# EasyEDA Pro project 111智能加湿器.eprj (continued)
## Notes on the sheets (continued)
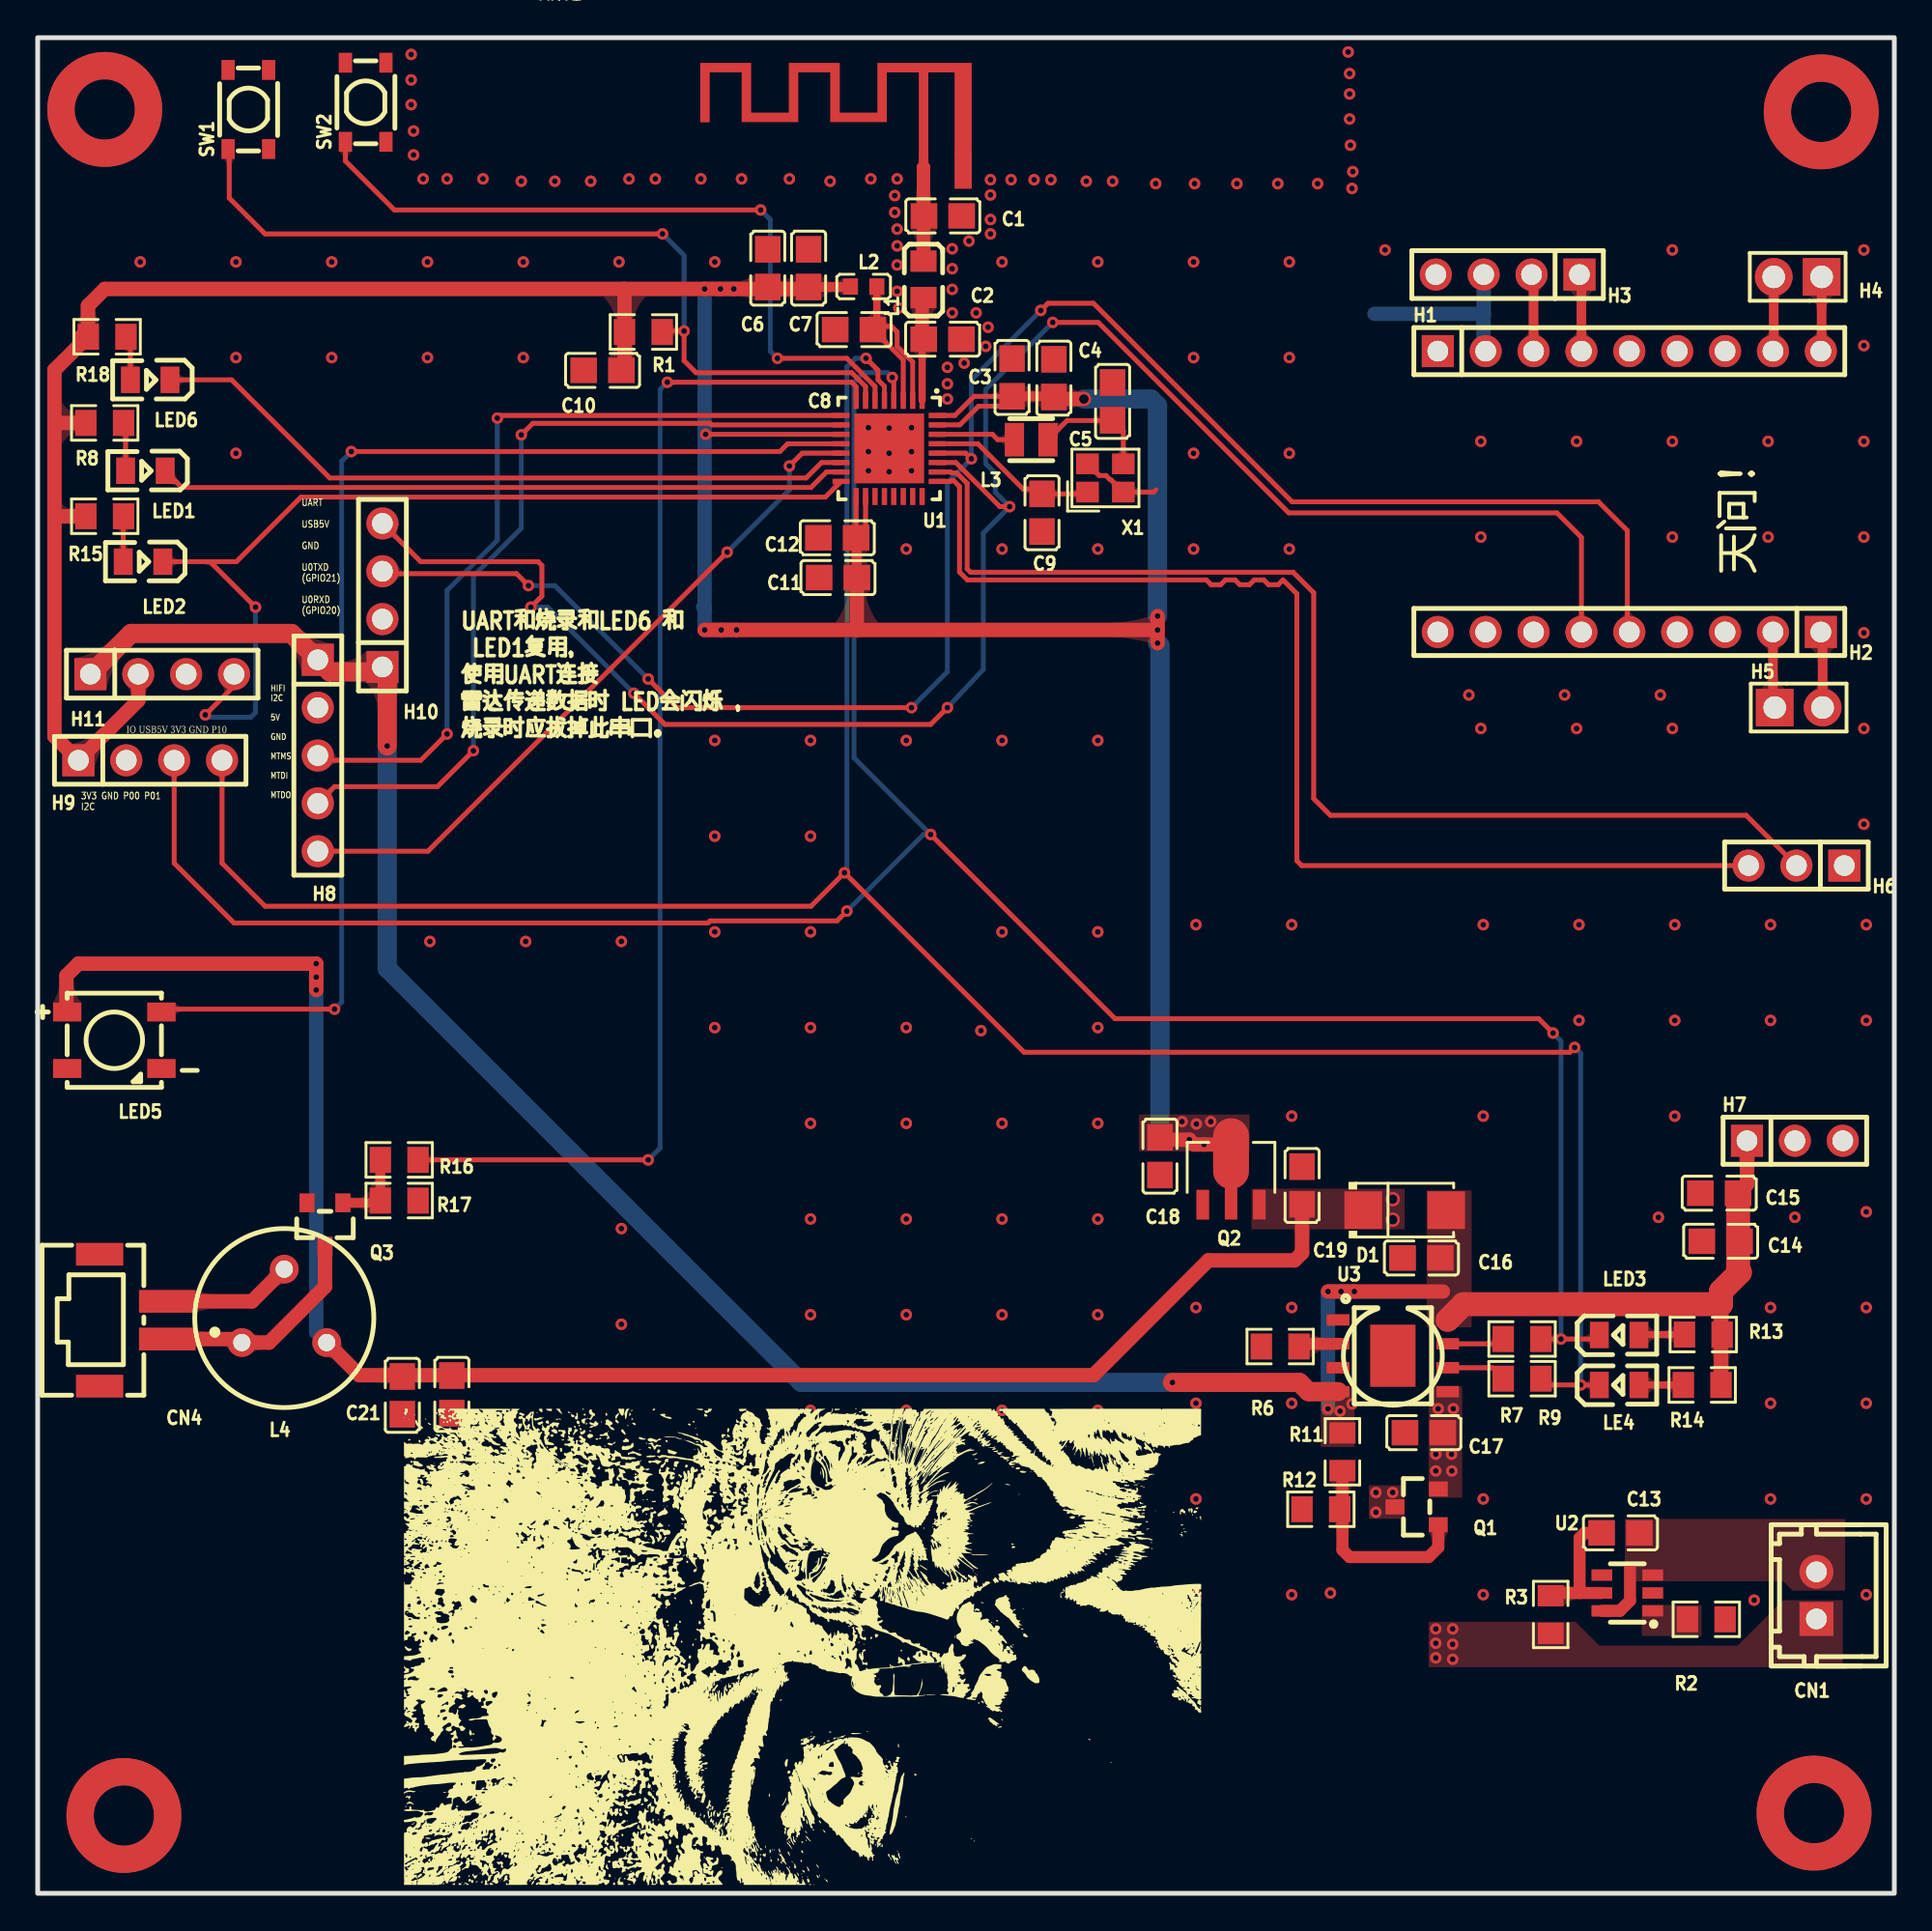
[diagram p3: board, top side]
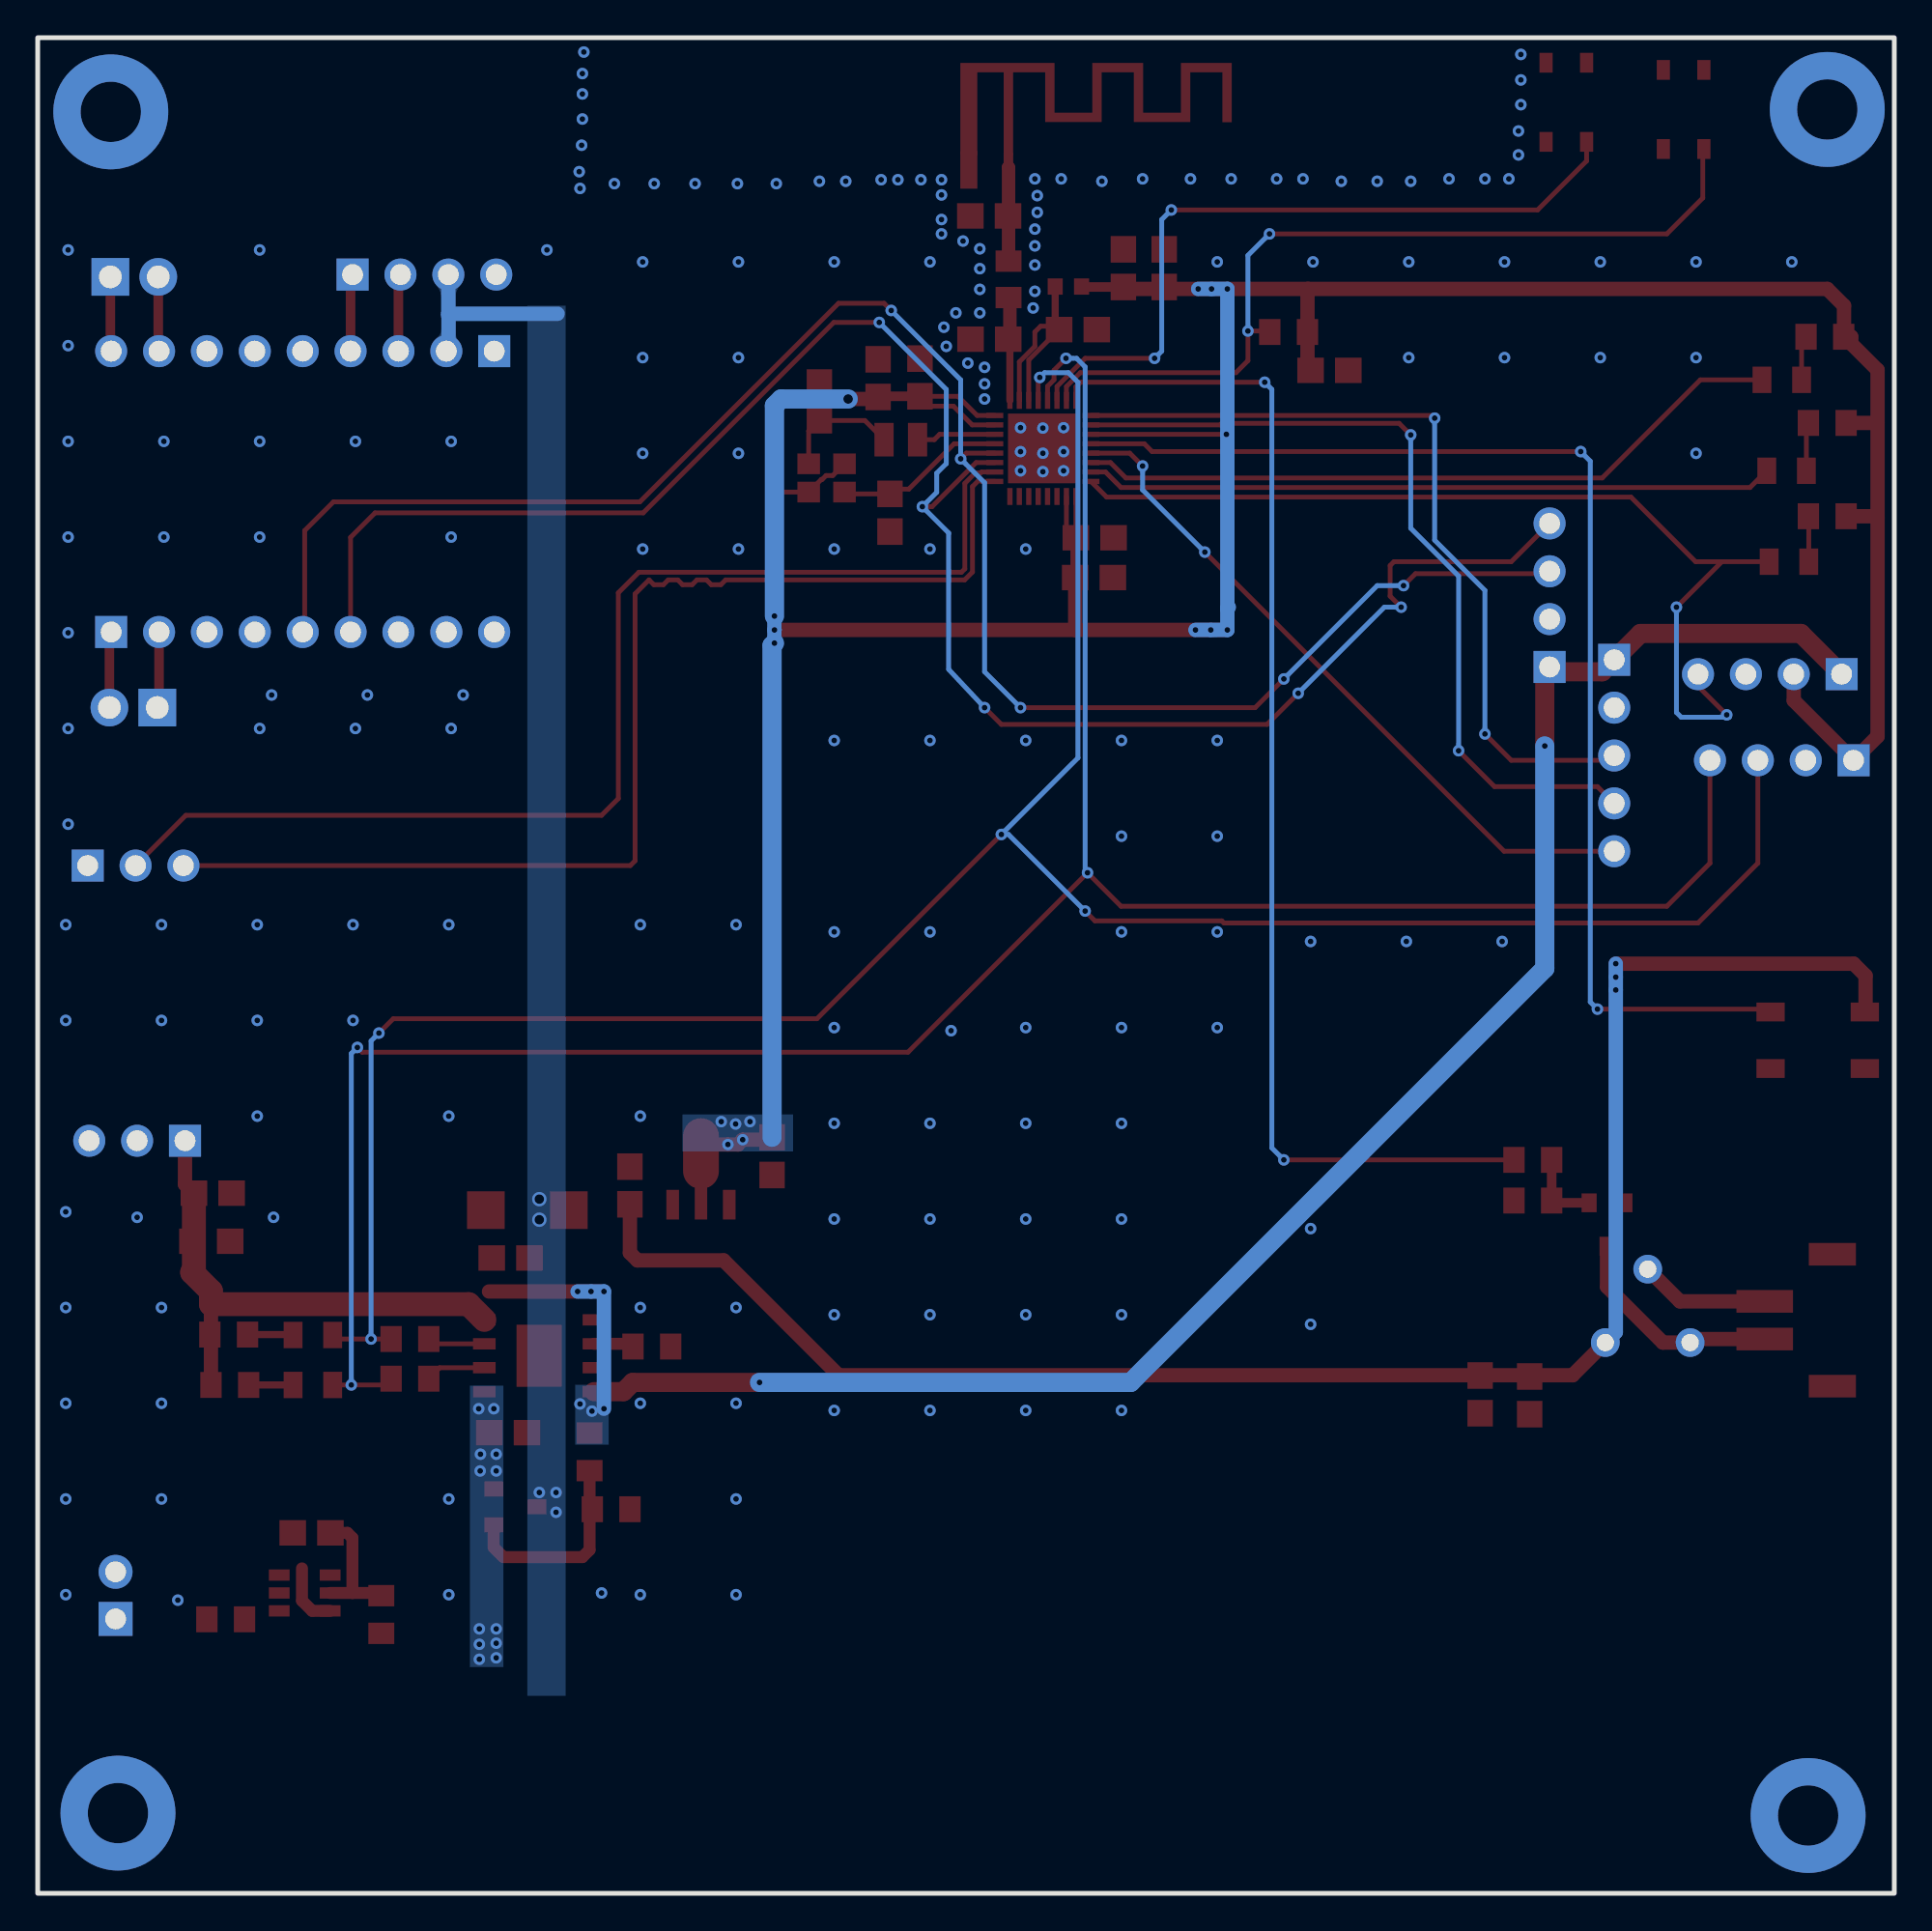
[diagram p4: board, bottom side, seen from below]

Outline 98.49 x 98.49 mm; copper layers: Top Layer, Bottom Layer. Coordinates in mm from the lower left corner of the outline.
Outline path: rectangle 0,98.49 98.49,0
Stack: Top Layer 0.035mm / Dielectric1 1.51mm FR4 er 4.5 / Bottom Layer 0.035mm

## Design rules (mm)
net P19: DP1
net P18: DP1
template: JLCPCB Capability(Two Layers Board)
spacing copperThickness1oz (default): track to track 0.102, other pairs 0.152 to 0.3
spacing copperThickness2oz: track to track 0.203, other pairs 0.152 to 0.3
track width copperThickness1oz (default): min 0.127, default 0.254, max 2.54
track width copperThickness2oz: min 0.203, default 0.254, max 2.54
differential pair differentialPair (default): width min 0.127, default 0.254, max 2.54; gap min 0.152, default 0.152
via viaSize (default): diameter min 0.5, default 0.61, max 10; hole min 0.3, default 0.305, max 6.3

## Placement (name value [footprint] x y rotation side)
ANT1  -  [2.4g-pcb天线]  46.99 91.63 0 top
C1  3.3pF  [C0805]  48.02 89.03 0 top
C2  3.3pF  [C0805]  48.01 82.49 0 top
C3  10nF  [C0805]  51.69 80.46 90 top
C4  1uF  [C0805]  53.91 80.42 90 top
C5  15pF  [C0805]  57.02 79.19 270 top
C6  10uF  [C0805]  38.73 86.26 270 top
C7  100nF  [C0805]  40.9 86.26 270 top
C8  1uF  [C0805]  43.31 83 0 top
C9  15pF  [C0805]  53.28 73.28 270 top
C10  100nF  [C0805]  29.97 80.83 0 top
C11  100nF  [C0805]  42.45 69.84 0 top
C12  100nF  [C0805]  42.42 71.95 0 top
C13  100nF  [C0805]  83.96 19.13 180 top
C14  10uF  [C0805]  89.28 34.61 0 top
C15  100nF  [C0805]  89.21 37.16 180 top
C16  100nF  [C0805]  73.41 33.72 180 top
C17  100nF  [C0805]  73.53 24.45 180 top
C18  10uF  [C0805]  59.53 39.13 90 top
C19  10uF  [C0805]  67.08 37.57 270 top
C20  10uF  [C0805]  21.97 26.48 90 top
C21  100nF  [C0805]  19.34 26.43 90 top
CN1  ZX-XH2.54-2PZZ  [CONN-TH_2P-P2.50_HX25003-2A]  94.36 15.81 90 top
CN4  WF-1E200A2P  [CONN-SMD_2P-P2.00_WF-1E200A2P]  5.08 30.42 270 top
D1  SS14  [SMA_L4.3-W2.6-LS5.1-RD]  72.52 36.26 0 top
H1  PZ254V-11-09P  [HDR-TH_9P-P2.54-V-M]  84.44 81.85 0 top
H2  PZ254V-11-09P  [HDR-TH_9P-P2.54-V-M]  84.44 66.95 180 top
H3  PZ254V-11-04P  [HDR-TH_4P-P2.54-V-M]  77.98 85.92 180 top
H4  PZ254V-11-02P  [HDR-TH_2P-P2.54-V-M]  93.37 85.8 180 top
H5  PZ254V-11-02P  [HDR-TH_2P-P2.54-V-M]  93.42 62.94 0 top
H6  PZ254V-11-03P  [HDR-TH_3P-P2.54-V-M]  93.3 54.55 180 top
H7  PZ254V-11-03P  [HDR-TH_3P-P2.54-V-M]  93.22 39.94 0 top
H8  PZ254V-11-05P  [HDR-TH_5P-P2.54-V-M]  14.86 60.39 270 top
H9  PZ254V-11-04P  [HDR-TH_4P-P2.54-V-M]  5.97 60.14 0 top
H10  PZ254V-11-04P  [HDR-TH_4P-P2.54-V-M]  18.29 68.9 90 top
H11  PZ254V-11-04P  [HDR-TH_4P-P2.54-V-M]  6.6 64.71 0 top
L1  2.2nH  [L0805]  46.99 85.66 90 top
L2  2nH  [L0603]  43.81 85.28 0 top
L3  24nH  [IND-SMD_L2.3-W1.7]  52.71 77.16 0 top
L4  XR8*10-300K-152K-L  [IND-TH_3P-BD9.5_XR8X10-300K-152K-L]  13.08 31.18 0 top
LE4  NCD0805R1  [LED0805-R-RD]  83.89 26.98 0 top
LED1  NCD0805R1  [LED0805-R-RD]  5.72 75.5 180 top
LED2  NCD0805R1  [LED0805-R-RD]  5.59 70.68 180 top
LED3  NCD0805R1  [LED0805-R-RD]  83.89 29.63 0 top
LED5  XL-5050RGBC-WS2812B  [LED-SMD_4P-L5.0-W5.0-BL_XL-5050RGBC]  4.06 45.28 270 top
LED6  NCD0805R1  [LED0805-R-RD]  5.97 80.33 180 top
Q1  AO3401A  [SOT-23_L2.9-W1.3-P1.90-LS2.4-BR]  73.15 20.51 0 top
Q2  AMS1117-3.3V  [SOT-89-3_L4.5-W2.5-P1.50-LS4.2-BR]  63.31 37.91 270 top
Q3  AO3400  [SOT-23_L2.9-W1.3-P1.90-LS2.4-BR]  15.24 35.5 90 top
R1  10kΩ  [R0805]  32.13 82.87 0 top
R2  1kΩ  [R0805]  88.52 14.54 180 top
R3  100Ω  [R0805]  80.26 14.8 270 top
R6  1.2kΩ  [R0805]  65.91 29.02 0 top
R7  1kΩ  [R0805]  78.74 29.42 0 top
R8  2kΩ  [R0805]  3.56 78.04 0 top
R9  1kΩ  [R0805]  78.74 27.31 0 top
R11  100Ω  [R0805]  69.22 23.43 270 top
R12  1kΩ  [R0805]  68.07 20.39 0 top
R13  510Ω  [R0805]  88.36 29.66 0 top
R14  510Ω  [R0805]  88.3 26.98 0 top
R15  2kΩ  [R0805]  3.56 73.09 0 top
R16  0Ω  [R0805]  19.18 38.93 180 top
R17  100kΩ  [R0805]  19.18 36.77 180 top
R18  2kΩ  [R0805]  3.68 82.62 0 top
SW1  SKRPACE010  [KEY-SMD_4P-L4.2-W3.2-P2.20-LS4.6]  11.18 94.68 90 top
SW2  SKRPACE010  [KEY-SMD_4P-L4.2-W3.2-P2.20-LS4.6]  17.4 95.06 90 top
U1  ESP32-C3FN4  [VFQFN-32_L5.0-W5.0-P0.50-TL-EP3.7]  45.17 76.69 270 top
U2  XB5306A  [SOT-23-6_L2.9-W1.6-P0.95-LS2.8-BR]  84.33 15.94 0 top
U3  TC4056A.  [ESOP-8_L4.9-W3.9-P1.27-LS6.0-BL-EP]  71.89 28.53 270 top
X1  40MHz  [CRYSTAL-SMD_4P-L2.5-W2.0-BL]  56.64 75.12 0 top

## Footprints (pads in the part's own frame, mm; a bottom-side part is the same pattern mirrored in y, then rotated)
2.4g-pcb天线
  rect 0.508x1.524 smd: 1(0.006,-0.013)
  rect 0.905x2 smd: 2(2.106,-0.158)
C0805
  rect 1.41x1.35 smd: 1(-1,0) 2(1,0)
CONN-SMD_2P-P2.00_WF-1E200A2P
  rect 1.2x3 smd: 1(-1,1.795) 2(1,1.795)
  rect 1.2x2.5 smd: 3(3.5,-1.795) 4(-3.5,-1.795)
CONN-TH_2P-P2.50_HX25003-2A
  rect 1.8x1.8 hole 1.1: 1(-1.25,0)
  round 1.8 hole 1.1: 2(1.25,0)
CRYSTAL-SMD_4P-L2.5-W2.0-BL
  rect 1.2x1.1 smd: 1(-0.95,-0.75) 2(0.95,-0.75) 3(0.95,0.75) 4(-0.95,0.75)
ESOP-8_L4.9-W3.9-P1.27-LS6.0-BL-EP
  rect 0.6x1.2 smd: 1(-1.905,-2.909) 2(-0.635,-2.909) 3(0.635,-2.909) 4(1.905,-2.909) 5(1.905,2.909) 6(0.635,2.909) 7(-0.635,2.909) 8(-1.905,2.909)
  rect 3.3x2.4 smd: 9(0,0)
HDR-TH_2P-P2.54-V-M
  rect 2x2 hole 1.2: 1(-1.27,0)
  round 2 hole 1.2: 2(1.27,0)
HDR-TH_3P-P2.54-V-M
  rect 1.7x1.7 hole 1.1: 1(-2.54,0)
  round 1.7 hole 1.1: 2(0,0) 3(2.54,0)
HDR-TH_4P-P2.54-V-M
  rect 1.7x1.7 hole 1.1: 1(-3.81,0)
  round 1.7 hole 1.1: 2(-1.27,0) 3(1.27,0) 4(3.81,0)
HDR-TH_5P-P2.54-V-M
  rect 1.7x1.7 hole 1.1: 1(-5.08,0)
  round 1.7 hole 1.1: 2(-2.54,0) 3(0,0) 4(2.54,0) 5(5.08,0)
HDR-TH_9P-P2.54-V-M
  rect 1.7x1.7 hole 1.1: 1(-10.16,0)
  round 1.7 hole 1.1: 2(-7.62,0) 3(-5.08,0) 4(-2.54,0) 5(0,0) 6(2.54,0) 7(5.08,0) 8(7.62,0) 9(10.16,0)
IND-SMD_L2.3-W1.7
  rect 1.02x1.78 smd: 1(-0.89,0) 2(0.89,0)
IND-TH_3P-BD9.5_XR8X10-300K-152K-L
  round 1.524 hole 0.914: 1(-2.25,-1.948) 2(0,1.948) 3(2.25,-1.948)
KEY-SMD_4P-L4.2-W3.2-P2.20-LS4.6
  rect 1.05x0.7 smd: 1(-2.1,1.075) 2(2.1,1.075) 3(-2.1,-1.075) 4(2.1,-1.075)
L0603
  rect 0.8x0.864 smd: 1(-0.7,0) 2(0.7,0)
L0805
  rect 1.133x1.377 smd: 1(-0.966,0) 2(0.966,0)
LED0805-R-RD
  rect 1x1.399 smd: 1(1.05,0) 2(-1.05,0)
LED-SMD_4P-L5.0-W5.0-BL_XL-5050RGBC
  rect 1x1.5 smd: 1(-1.5,-2.5) 2(1.5,-2.5) 3(1.5,2.5) 4(-1.5,2.5)
R0805
  rect 1.133x1.377 smd: 1(-1,0) 2(1,0)
SMA_L4.3-W2.6-LS5.1-RD
  rect 2x2 smd: 1(-2.2,0) 2(2.2,0)
SOT-23-6_L2.9-W1.6-P0.95-LS2.8-BR
  rect 1.1x0.6 smd: 1(1.35,-0.95) 2(1.35,0) 3(1.35,0.95) 4(-1.35,0.95) 5(-1.35,0) 6(-1.35,-0.95)
SOT-23_L2.9-W1.3-P1.90-LS2.4-BR
  rect 1x0.8 smd: 1(1.15,-0.95) 2(1.15,0.95) 3(-1.15,0)
SOT-89-3_L4.5-W2.5-P1.50-LS4.2-BR
  rect 1.575x0.672 smd: 1(1.356,-1.5) 3(1.356,1.5)
  custom 0x0 smd: 2(-1.356,0)
VFQFN-32_L5.0-W5.0-P0.50-TL-EP3.7
  rect 0.9x0.28 smd: 1(-2.55,1.75) 2(-2.55,1.25) 3(-2.55,0.75) 4(-2.55,0.249) 5(-2.55,-0.249) 6(-2.55,-0.749) 7(-2.55,-1.25) 8(-2.55,-1.75) 17(2.55,-1.75) 18(2.55,-1.25) 19(2.55,-0.749) 20(2.55,-0.249) 21(2.55,0.249) 22(2.55,0.75) 23(2.55,1.25) 24(2.55,1.75)
  rect 0.28x0.9 smd: 9(-1.75,-2.55) 10(-1.25,-2.55) 11(-0.75,-2.55) 12(-0.249,-2.55) 13(0.249,-2.55) 14(0.749,-2.55) 15(1.25,-2.55) 16(1.75,-2.55) 25(1.75,2.55) 26(1.25,2.55) 27(0.749,2.55) 28(0.249,2.55) 29(-0.249,2.55) 30(-0.75,2.55) 31(-1.25,2.55) 32(-1.75,2.55)
  rect 3.7x3.7 smd: 33(0,0)

## Nets
As in the schematic, except:
GND: ANT1.2 C1.2 C2.2 C3.2 C4.2 C5.1 C6.1 C7.1 C8.1 C9.2 C10.1 C11.1 C12.1 C14.1 C15.2 C16.2 C17.2 C18.1 C19.1 C20.1 C21.1 CN4.3 CN4.4 H1.1 H3.4 H7.3 H8.2 H9.2 H10.2 H11.3 LED5.3 Q2.1 Q3.2 R2.1 R6.1 R12.1 R17.1 SW1.4 SW2.4 U1.33 U2.2 U3.1 U3.3 U3.9 X1.2 X1.4
$1N1022: ANT1.1 C1.1 L1.2
$1N1039: C9.1 U1.29 X1.1
$1N1041: C5.2 L3.2 X1.3

Pads without a net: H1 5 6 7; H2 3 4 7 8 9; H6 1; H7 2; LED5 2; SW1 2 3; SW2 2 3; U1 19 20 21 22 23 24; U2 4

## Via types
v1: diameter 0.61, hole 0.305, Top Layer to Bottom Layer, 263 vias
v2: diameter 6.096, hole 3.2, Top Layer to Bottom Layer, 4 vias
v3: diameter 0.762, hole 0.508, Top Layer to Bottom Layer, 3 vias

## Routing (per net, layer and track width the routed paths; a pad name or vN(x,y) marks a point on that pad's centre or on a via; arc(x,y) is an arc through that point)
3V3: length 204.4
  Top Layer w0.254: C12.2 43.92,72.45 43.92,74.14 ; 47.72,78.44 48.66,78.44 49.67,79.46 C3.1 51.16,78.93 49.91,78.93 48.92,77.94 47.72,77.94 ; 0.97,73.09 0.89,73.01 ; U1.17 43.42,71.95 ; U1.11 v1(35.43,77.44)
  Top Layer w0.508: C12.2 43.45,71.91 C11.2 ; L2.1 43.09,85.26 C7.2 ; C3.1 53.87,79.46
  Top Layer w0.762: v1(59.41,67.06) 43.45,67.06 ; v1(59.41,67.06) v1(59.41,67.79) ; v1(59.41,67.06) v1(59.41,66.36) ; 43.45,67.06 C11.2 ; 43.45,67.06 v1(37.07,67.06) v1(36.26,67.06) v1(35.38,67.06) ; 2.29,82.25 2.29,82.62 2.65,82.62 ; 2.29,82.25 0.89,80.85 0.89,78.05 ; 2.29,82.25 2.65,82.62 ; 38.63,85.16 C6.2 ; 38.63,85.16 40.79,85.16 C7.2 ; 38.63,85.16 v1(36.93,85.16) v1(36.22,85.16) v1(35.38,85.16) 31.1,85.16 ; 2.65,82.62 2.67,82.63 2.67,84.27 3.56,85.16 31.1,85.16 ; 2.65,82.62 R18.1 ; 31.1,85.16 31.13,85.13 R1.1 31.13,81 C10.2 ; 0.89,78.05 0.89,61.41 H9.1 5.33,63.31 H11.2 ; 0.89,78.05 0.89,78.04 R8.1 ; C4.1 54.01,79.31 v3(55.5,79.31) ; Q2.2 62.82,39.75 v1(61.88,39.75) 61.35,39.75 v1(61.09,40) 59.66,40 C18.2 ; R15.1 0.97,73.09
  Bottom Layer w0.254: 35.38,77.45 35.39,77.44 v1(35.43,77.44)
  Bottom Layer w0.762: 35.38,68.19 35.31,68.27 ; 35.38,68.19 v1(35.38,67.06) v1(36.26,67.06) v1(37.07,67.06) ; 35.38,68.19 v1(35.38,85.16) v1(36.22,85.16) v1(36.93,85.16) ; v1(59.41,67.79) v1(59.41,67.06) v1(59.41,66.36)
  Bottom Layer w1.016: v1(59.41,66.36) 59.53,66.23 C18.2 ; v1(59.41,67.79) 59.41,78.96 59.06,79.31 v3(55.5,79.31)
  vias: v1(60.71,40.96) v1(61.47,40.83) v1(62.23,40.96)
GND: length 4.3
  Top Layer w0.254: 59.31,74.49 59.19,74.37 X1.2 56.92,75.04 56.88,75.04 56.67,75.25 56.31,75.25 X1.4
  vias: v1(5.44,86.59) v1(10.52,86.59) v1(10.52,81.51) v1(10.52,76.43) v1(15.6,86.59) v1(15.6,81.51) v1(19.81,97.6) v1(19.81,96.25) v1(19.81,94.94) v1(19.94,93.54) v1(19.94,92.27) v1(20.45,91) v1(20.68,86.59) v1(20.68,81.51) v1(20.8,50.52) v1(21.72,91) v1(23.62,91) v1(25.65,90.87) v1(25.76,86.59) v1(25.76,81.51) v1(25.89,50.52) v1(27.43,90.87) v1(29.34,90.87) v1(30.84,86.59) v1(30.97,50.52) v1(30.97,35.28) v1(30.97,30.2) v1(31.37,91) v1(32.77,91) v1(35.18,91) v1(35.92,86.59) v1(35.92,61.19) v1(35.92,56.11) v1(35.92,51.03) v1(35.92,45.95) v1(37.34,91) v1(39.88,91) v1(41,61.19) v1(41,56.11) v1(41,51.03) v1(41,45.95) v1(41,40.87) v1(41,35.79) v1(41,30.71) v1(41,25.63) v1(42.04,90.87) v1(44.07,77.79) v1(44.07,76.52) v1(44.07,75.5) v1(44.2,91) v1(45.17,77.77) v1(45.17,76.43) v1(45.17,75.46) v1(45.47,90.11) v1(45.47,89.22) v1(45.59,91) v1(45.59,88.33) v1(45.59,87.44) v1(45.59,86.43) v1(45.59,85.03) v1(45.68,84.15) v1(46.08,71.35) v1(46.08,61.19) v1(46.08,45.95) v1(46.08,40.87) v1(46.08,35.79) v1(46.08,30.71) v1(46.08,25.63) v1(46.35,77.79) v1(46.35,76.52) v1(46.35,75.5) v1(48.26,80.99) v1(48.26,80.12) v1(48.26,79.31) v1(48.51,87.29) v1(48.51,86.23) v1(48.51,85.13) v1(48.51,83.89) v1(49.15,81.22) v1(49.4,87.7) v1(49.78,83.89) v1(50.04,45.79) v1(50.29,82.11) v1(50.42,83.12) v1(50.55,90.95) v1(50.55,90.14) v1(50.55,88.84) v1(50.55,88.08) v1(51.16,86.59) v1(51.16,71.35) v1(51.16,61.19) v1(51.16,51.03) v1(51.16,40.87) v1(51.16,35.79) v1(51.16,30.71) v1(51.16,25.63) v1(51.64,90.95) v1(52.86,90.95) v1(53.75,90.95) v1(55.63,90.87) v1(56.24,86.59) v1(56.24,71.35) v1(56.24,61.19) v1(56.24,51.03) v1(56.24,45.95) v1(56.24,40.87) v1(56.24,35.79) v1(56.24,30.71) v1(56.24,25.63) v1(57.02,90.87) v1(59.31,90.74) v1(61.37,90.74) v1(61.32,86.59) v1(61.32,81.51) v1(61.32,76.43) v1(61.32,71.35) v1(61.44,51.41) v1(61.44,31.09) v1(61.44,26.01) v1(61.44,20.93) v1(61.44,15.85) v1(63.62,90.74) v1(65.79,90.74) v1(66.4,86.59) v1(66.4,81.51) v1(66.4,76.43) v1(66.4,71.35) v1(66.53,51.41) v1(66.53,41.25) v1(66.53,31.09) v1(66.53,26.01) v1(66.53,15.85) v1(67.9,90.74) v1(68.58,15.94) v1(69.52,97.73) v1(69.6,96.59) v1(69.6,95.5) v1(69.6,94.17) v1(69.64,92.78) v1(69.77,91.38) v1(69.72,90.49) v1(71.48,87.23) v1(75.92,63.6) v1(76.56,77.07) v1(76.56,71.99) v1(76.56,61.83) v1(76.69,51.41) v1(76.69,41.25) v1(76.69,20.93) v1(76.69,15.85) v1(81,63.6) v1(81.64,77.07) v1(81.64,61.83) v1(81.76,51.41) v1(81.76,46.33) v1(85.98,35.88) v1(86.08,63.6) v1(86.72,87.23) v1(86.72,77.07) v1(86.72,71.99) v1(86.72,61.83) v1(86.84,51.41) v1(86.84,46.33) v1(86.84,41.25) v1(91.06,15.56) v1(91.8,77.07) v1(91.8,71.99) v1(91.93,51.41) v1(91.93,46.33) v1(91.93,31.09) v1(91.93,26.01) v1(91.93,20.93) v1(93.22,35.88) v1(96.88,87.23) v1(96.88,82.15) v1(96.88,77.07) v1(96.88,71.99) v1(96.88,66.91) v1(96.88,61.83) v1(96.88,56.75) v1(97,51.41) v1(97,46.33) v1(97,36.17) v1(97,31.09) v1(97,26.01) v1(97,20.93) v1(97,15.85) v2(3.56,94.68) v2(4.57,4.13) v2(94.23,4.26) v2(94.62,94.55)
VCC: length 105.3
  Top Layer w0.762: 19.79,27.5 17.07,27.5 L4.3 ; 19.79,27.5 19.47,27.18 ; 19.79,27.5 56.01,27.5 62.1,33.59 66.68,33.59 67.08,33.99 C19.2 ; v1(14.78,47.95) v1(14.78,48.63) v1(14.78,49.34) 2.16,49.34 1.52,48.71 1.52,46.82 LED5.1
  Bottom Layer w0.762: 76.71,83.84 76.71,83.73 76.7,83.72 76.7,81.97 H1.2 ; 76.71,83.84 H3.3 ; 76.71,83.84 70.92,83.84 ; v1(14.78,49.34) v1(14.78,48.63) v1(14.78,47.95) 14.78,29.79 L4.3
  vias: v1(70.99,21.28) v1(70.99,20.23) v1(71.88,21.28) v3(71.88,36.84) v3(71.88,35.75)
BAT+:
  vias: v1(74.17,23.31) v1(74.17,22.42) v1(74.17,14.04) v1(74.17,13.27) v1(74.17,12.5) v1(74.29,25.72) v1(75.1,25.72) v1(75,23.31) v1(75.02,22.42) v1(75.06,14.04) v1(75.06,13.22) v1(75.06,12.42)
BAT-: length 3.4
  Top Layer w0.635: U2.6 83.93,14.99 84.47,15.53 84.47,17.25
BCLK: length 43.7
  Top Layer w0.254: H8.3 15.11,60.14 20.32,60.14 v1(21.72,61.53) ; U1.9 24.53,78.44 v1(24.38,78.3)
  Bottom Layer w0.254: v1(21.72,61.53) 21.72,69.15 24.38,71.82 v1(24.38,78.3)
DIN: length 37.3
  Top Layer w0.254: H8.5 20.7,55.31 v1(36.58,71.19) ; v1(39.88,75.76) 40.56,76.44 U1.13
  Bottom Layer w0.254: v1(39.88,75.76) 39.88,74.49 v1(36.58,71.19)
LRCK: length 44.5
  Top Layer w0.254: U1.10 35.76,77.94 35.68,78.02 26.27,78.02 v1(25.65,77.41) ; 14.86,57.85 15.75,58.74 21.21,58.74 v1(23.11,60.65)
  Bottom Layer w0.254: v1(25.65,77.41) 25.65,72.46 23.11,69.92 v1(23.11,60.65)
P00: length 135.1
  Top Layer w0.254: LED3.2 82.63,29.42 v1(80.81,29.42) R7.2 ; v1(47.37,56.2) 57.15,46.42 79.63,46.42 v1(80.39,45.66) ; H9.3 7.24,54.68 10.41,51.5 35.56,51.5 35.68,51.61 42.4,51.61 v1(42.93,52.14) ; v1(45.33,80.46) 45.42,80.37 U1.4
  Bottom Layer w0.254: v1(80.39,45.66) 80.81,45.24 v1(80.81,29.42) ; v1(42.93,52.14) 46.99,56.2 v1(47.37,56.2) 43.31,60.26 43.31,80.2 43.81,80.71 45.08,80.71 v1(45.33,80.46)
P01: length 135
  Top Layer w0.254: v1(81.53,44.9) 81.28,44.64 52.32,44.64 v1(42.8,54.17) 41.02,52.39 12.06,52.39 9.78,54.68 H9.4 ; LE4.2 v1(81.85,26.98) 80.08,26.98 R9.2 ; v1(43.94,81.47) 44.58,80.84 44.58,80.33 44.92,79.99 U1.5
  Bottom Layer w0.254: v1(81.85,26.98) 81.85,44.58 v1(81.53,44.9) ; v1(43.94,81.47) 43.38,81.47 42.93,81.02 42.93,54.3 v1(42.8,54.17)
P02: length 38.9
  Top Layer w0.254: v1(39.24,81.47) 42.92,81.47 44.42,79.98 U1.6 ; v1(38.35,89.35) 18.92,89.35 16.32,91.95 SW2.1
  Bottom Layer w0.254: v1(38.35,89.35) 38.86,88.84 38.86,81.85 v1(39.24,81.47)
P03: length 64.7
  Top Layer w0.254: U1.8 43.42,79.97 43.18,80.2 v1(33.4,80.2) ; v1(32.38,38.93) R16.1
  Bottom Layer w0.254: v1(32.38,38.93) 33.02,39.56 33.02,79.82 v1(33.4,80.2)
P06: length 65.4
  Top Layer w0.254: U1.12 39.79,76.94 39.37,76.52 v1(16.64,76.52) ; LED5.4 6.72,46.93 v1(15.75,46.93)
  Bottom Layer w0.254: v1(16.64,76.52) 16.13,76.02 16.13,47.31 v1(15.75,46.93)
P08: length 38.1
  Top Layer w0.254: LED6.2 10.29,80.33 15.49,75.12 40.77,75.12 41.58,75.94 U1.14
P09: length 36.6
  Top Layer w0.254: U1.15 41.85,75.44 41.02,74.62 7.65,74.62 LED1.2
P10: length 52.7
  Top Layer w0.254: LED2.2 6.73,70.58 6.83,70.68 9.14,70.68 ; H11.4 10.41,64.07 v1(8.89,62.55) ; v1(11.56,68.27) 9.14,70.68 ; 9.14,70.68 10.54,70.68 13.97,74.11 41.79,74.11 U1.16
  Bottom Layer w0.254: v1(11.56,68.27) 11.56,62.68 11.3,62.42 8.76,62.42 v1(8.89,62.55)
P18: length 63.1
  Top Layer w0.254: H6.3 67.06,54.55 66.8,54.8 66.8,68.97 66.06,69.71 65.81,69.46 65.3,69.46 65.04,69.71 64.54,69.71 64.28,69.46 63.77,69.46 63.52,69.71 63.01,69.71 62.76,69.46 62.25,69.46 62,69.71 49.32,69.71 48.9,70.13 48.9,74.67 48.58,74.99 48.47,74.99 48.42,74.94 47.72,74.94
P19: length 63.3
  Top Layer w0.254: H6.2 90.63,57.22 68.58,57.22 67.69,58.11 67.69,69.03 66.6,70.12 49.49,70.12 49.31,70.3 49.31,74.84 48.75,75.39 48.47,75.39 48.42,75.44 47.72,75.44
RESET: length 45.7
  Top Layer w0.254: v1(33.15,88.08) 12.06,88.08 10.16,89.98 10.16,92.52 SW1.1 ; 43.92,79.24 43.92,79.97 43.18,80.71 34.93,80.71 34.29,81.35 v1(34.29,82.92) 33.18,82.92 R1.2
  Bottom Layer w0.254: v1(33.15,88.08) 34.29,86.93 v1(34.29,82.92)
U0RXD: length 103.3
  Top Layer w0.254: v1(51.56,73.6) 51.05,73.6 48.71,75.94 47.72,75.94 ; v1(48.26,62.93) 47.37,62.04 33.27,62.04 v1(31.62,63.69) ; v1(53.85,83.38) 56.26,83.38 66.37,73.27 80.59,73.27 81.9,71.97 H2.6 ; v1(26.16,68.27) 26.75,68.85 26.75,70.48 26.54,70.68 20.32,70.68 H10.4
  Bottom Layer w0.254: v1(26.16,68.27) 27.05,68.27 v1(31.62,63.69) ; v1(53.85,83.38) 50.29,79.82 50.29,75.89 50.8,75.38 50.8,74.36 v1(51.56,73.6) 50.16,72.2 50.16,64.96 v1(48.26,62.93)
U0TXD: length 98.4
  Top Layer w0.254: v1(49.53,76.14) 49.23,76.44 47.72,76.44 ; v1(46.35,62.93) 33.91,62.93 v1(32.38,64.46) ; v1(53.21,84.01) 53.59,84.39 56.01,84.39 66.55,73.85 82.8,73.85 84.33,72.33 84.33,67.05 H2.5 ; 18.41,70.04 25.4,70.04 v1(26.03,69.41)
  Bottom Layer w0.254: v1(46.35,62.93) 48.26,64.84 48.26,74.87 v1(49.53,76.14) 49.53,80.33 v1(53.21,84.01) ; v1(26.03,69.41) 27.43,69.41 v1(32.38,64.46)
USB5V: length 135.4
  Top Layer w0.254: H10.1 18.54,64.84
  Top Layer w0.762: v1(68.45,31.94) v1(69.14,31.94) v1(69.85,31.94) 74.55,31.94 ; C15.1 90.68,37.63 H7.1 ; R14.2 89.3,31.27
  Top Layer w1.016: v1(60.2,27.12) 66.93,27.12 67.42,26.63 U3.4 ; H11.1 4.95,66.87 13.46,66.87 H8.1 15.49,64.84 18.29,64.84 18.41,64.96 ; v1(18.54,60.9) 18.54,64.84
  Top Layer w1.27: C15.1 90.21,33.05 90.3,32.96 89.3,31.96 89.3,31.27 75.63,31.27 U3.8
  Bottom Layer w0.762: v1(68.45,25.72) v1(68.45,31.94) v1(69.14,31.94) 69.85,31.94
  Bottom Layer w1.016: v1(60.2,27.12) 40.51,27.12 18.54,49.09 v1(18.54,60.9)
  vias: v1(69.09,25.59) v1(69.72,25.97)
$1N1011: length 5.6
  Top Layer w0.381: C2.1 46.92,82.4 U1.1
  Top Layer w0.711: 46.92,82.4 46.92,84.63 L1.1
$1N1022: length 5
  Top Layer w0.711: 47,91.6 46.99,91.59 L1.2
$1N1039: length 9.1
  Top Layer w0.254: 47.72,76.94 49.87,76.94 52.28,74.53 53.02,74.53 C9.1 55.59,74.28 X1.1
$1N1041: length 6.4
  Top Layer w0.254: X1.3 57.59,77.62 57.04,78.17 54.61,78.17 L3.2
$1N1663: length 12
  Top Layer w0.254: U1.2 46.42,81.28 45.59,82.11 45.59,82.87 45.29,83.18 44.49,83.18 ; C8.2 45.92,81.39 U1.3
  Top Layer w0.381: C8.2 44.51,83.21 L2.2
$1N2808: length 4.2
  Top Layer w0.254: 47.72,77.44 50.64,77.44 50.93,77.16 L3.1
$2N2738: length 7
  Top Layer w0.635: 80.26,15.67 80.53,15.94 81.8,15.94 ; U2.5 81.8,15.94 ; 81.8,15.94 81.8,18.86 82.06,19.13 C13.2
$2N3092: length 2.1
  Top Layer w0.635: R6.2 67.06,29.17 U3.2
$2N3821: length 3.1
  Top Layer w0.254: R7.1 77.49,29.17 U3.7
$2N3825: length 3.2
  Top Layer w0.254: R9.1 77.16,27.9 U3.6
$2N4004: length 11.6
  Top Layer w0.635: 69.22,20.53 69.22,18.23 69.6,17.85 73.79,17.85 74.3,18.36 Q1.1 ; 69.22,20.53 R11.2 ; 69.22,20.53 R12.2
  Top Layer w0.762: R11.2 69.3,22.35 69.42,22.35 69.22,22.56
$2N7790: length 2.4
  Top Layer w0.381: 84.94,29.63 84.97,29.66 R13.1
$2N7839: length 2.4
  Top Layer w0.381: 84.94,26.98 R14.1
$3N327: length 2.4
  Top Layer w0.254: R18.2 4.92,82.38 LED6.1
$3N331: length 2.6
  Top Layer w0.254: LED1.1 4.66,77.94 R8.2
$3N336: length 2.4
  Top Layer w0.254: 4.45,73.07 4.54,72.98 LED2.1
$3N1125: length 4.1
  Top Layer w0.508: H1.3 79.35,85.81 79.25,85.92
$3N1126: length 4.1
  Top Layer w0.508: H1.4 81.9,85.81 H3.1
$3N1127: length 4
  Top Layer w0.508: H5.2 94.69,66.85 H2.1
$3N1128: length 4
  Top Layer w0.508: H5.1 92.06,63.03 H2.2
$3N1133: length 4
  Top Layer w0.508: H1.8 92.1,81.9 H4.2
$3N1134: length 4
  Top Layer w0.508: H4.1 94.64,81.9 H1.9
$3N1478: length 4.2
  Top Layer w0.508: Q3.1 18.06,36.65 R17.2 R16.2
$3N1481: length 6.9
  Top Layer w0.762: L4.2 11.37,31.42 CN4.1
$3N6150: length 11.8
  Top Layer w0.762: CN4.2 10.64,29.42 L4.1 12.28,29.23 15.24,32.2 Q3.3

## Copper pours and planes (outline as drawn; the poured copper is in the pictures)
3V3 on Top Layer: 58.42,41.34 64.29,41.34 64.29,39.38 58.42,39.38
3V3 on Bottom Layer: 58.42,41.34 64.29,41.34 64.29,39.38 58.42,39.38
GND on Top Layer: -2.67,107 108.84,107 108.84,18.86 -2.67,18.86
GND on Top Layer: -3.94,100.65 101.35,100.65 101.35,-3.49 -3.94,-3.49
GND on Top Layer: -4.06,102.56 102.62,102.56 102.62,-5.39 -4.06,-5.39
GND on Bottom Layer: -1.78,100.9 101.35,100.9 101.35,-2.6 -1.78,-2.6
GND on Bottom Layer: -20.83,101.92 100.33,101.92 100.33,8.19 -20.83,8.19
VCC on Top Layer: 64.39,37.4 72.52,37.4 72.52,35.25 64.39,35.25
VCC on Top Layer: 70.61,21.66 72.52,21.66 72.52,19.88 70.61,19.88
VCC on Bottom Layer: 70.48,84.27 72.52,84.27 72.52,10.48 70.48,10.48
BAT+ on Top Layer: 73.79,15.56 95.76,15.56 95.76,12 73.79,12
BAT+ on Top Layer: 73.79,26.9 75.56,26.9 75.56,20.99 73.79,20.99
BAT+ on Bottom Layer: 73.79,26.95 75.56,26.95 75.56,12 73.79,12
BAT- on Top Layer: 84.2,19.88 95.88,19.88 95.88,16.07 84.2,16.07
USB5V on Top Layer: 68.07,26.86 69.85,26.86 69.85,23.69 68.07,23.69
USB5V on Top Layer: 73.69,37.31 76.07,37.31 76.07,30.04 73.69,30.04
USB5V on Bottom Layer: 68.2,26.99 69.98,26.99 69.98,23.81 68.2,23.81
$2N2692 on Top Layer: 85.09,15.31 88.26,15.31 88.26,13.66 85.09,13.66

Small or netless copper shapes (teardrops, artwork), in the pictures only: 190 on Top Layer, 38 on Bottom Layer

## Text on the board
Top Silkscreen Layer: HIFI / I2C / 5V / GND / MTMS / MTDI / MTDO | 3V3 GND P00 P01 / I2C | UART / USB5V / GND / U0TXD / (GPIO21) / U0RXD / (GPIO20) | IO USB5V 3V3 GND P10 | UART和烧录和LED6 和 / LED1复用， / 使用UART连接 / 雷达传递数据时 LED会闪烁 ， / 烧录时应拔掉此串口。 | 天问！
